# Altium schematic sheet big sheet.SchDoc: <Enter Sheet Title> (part 1 of 2) (continued)
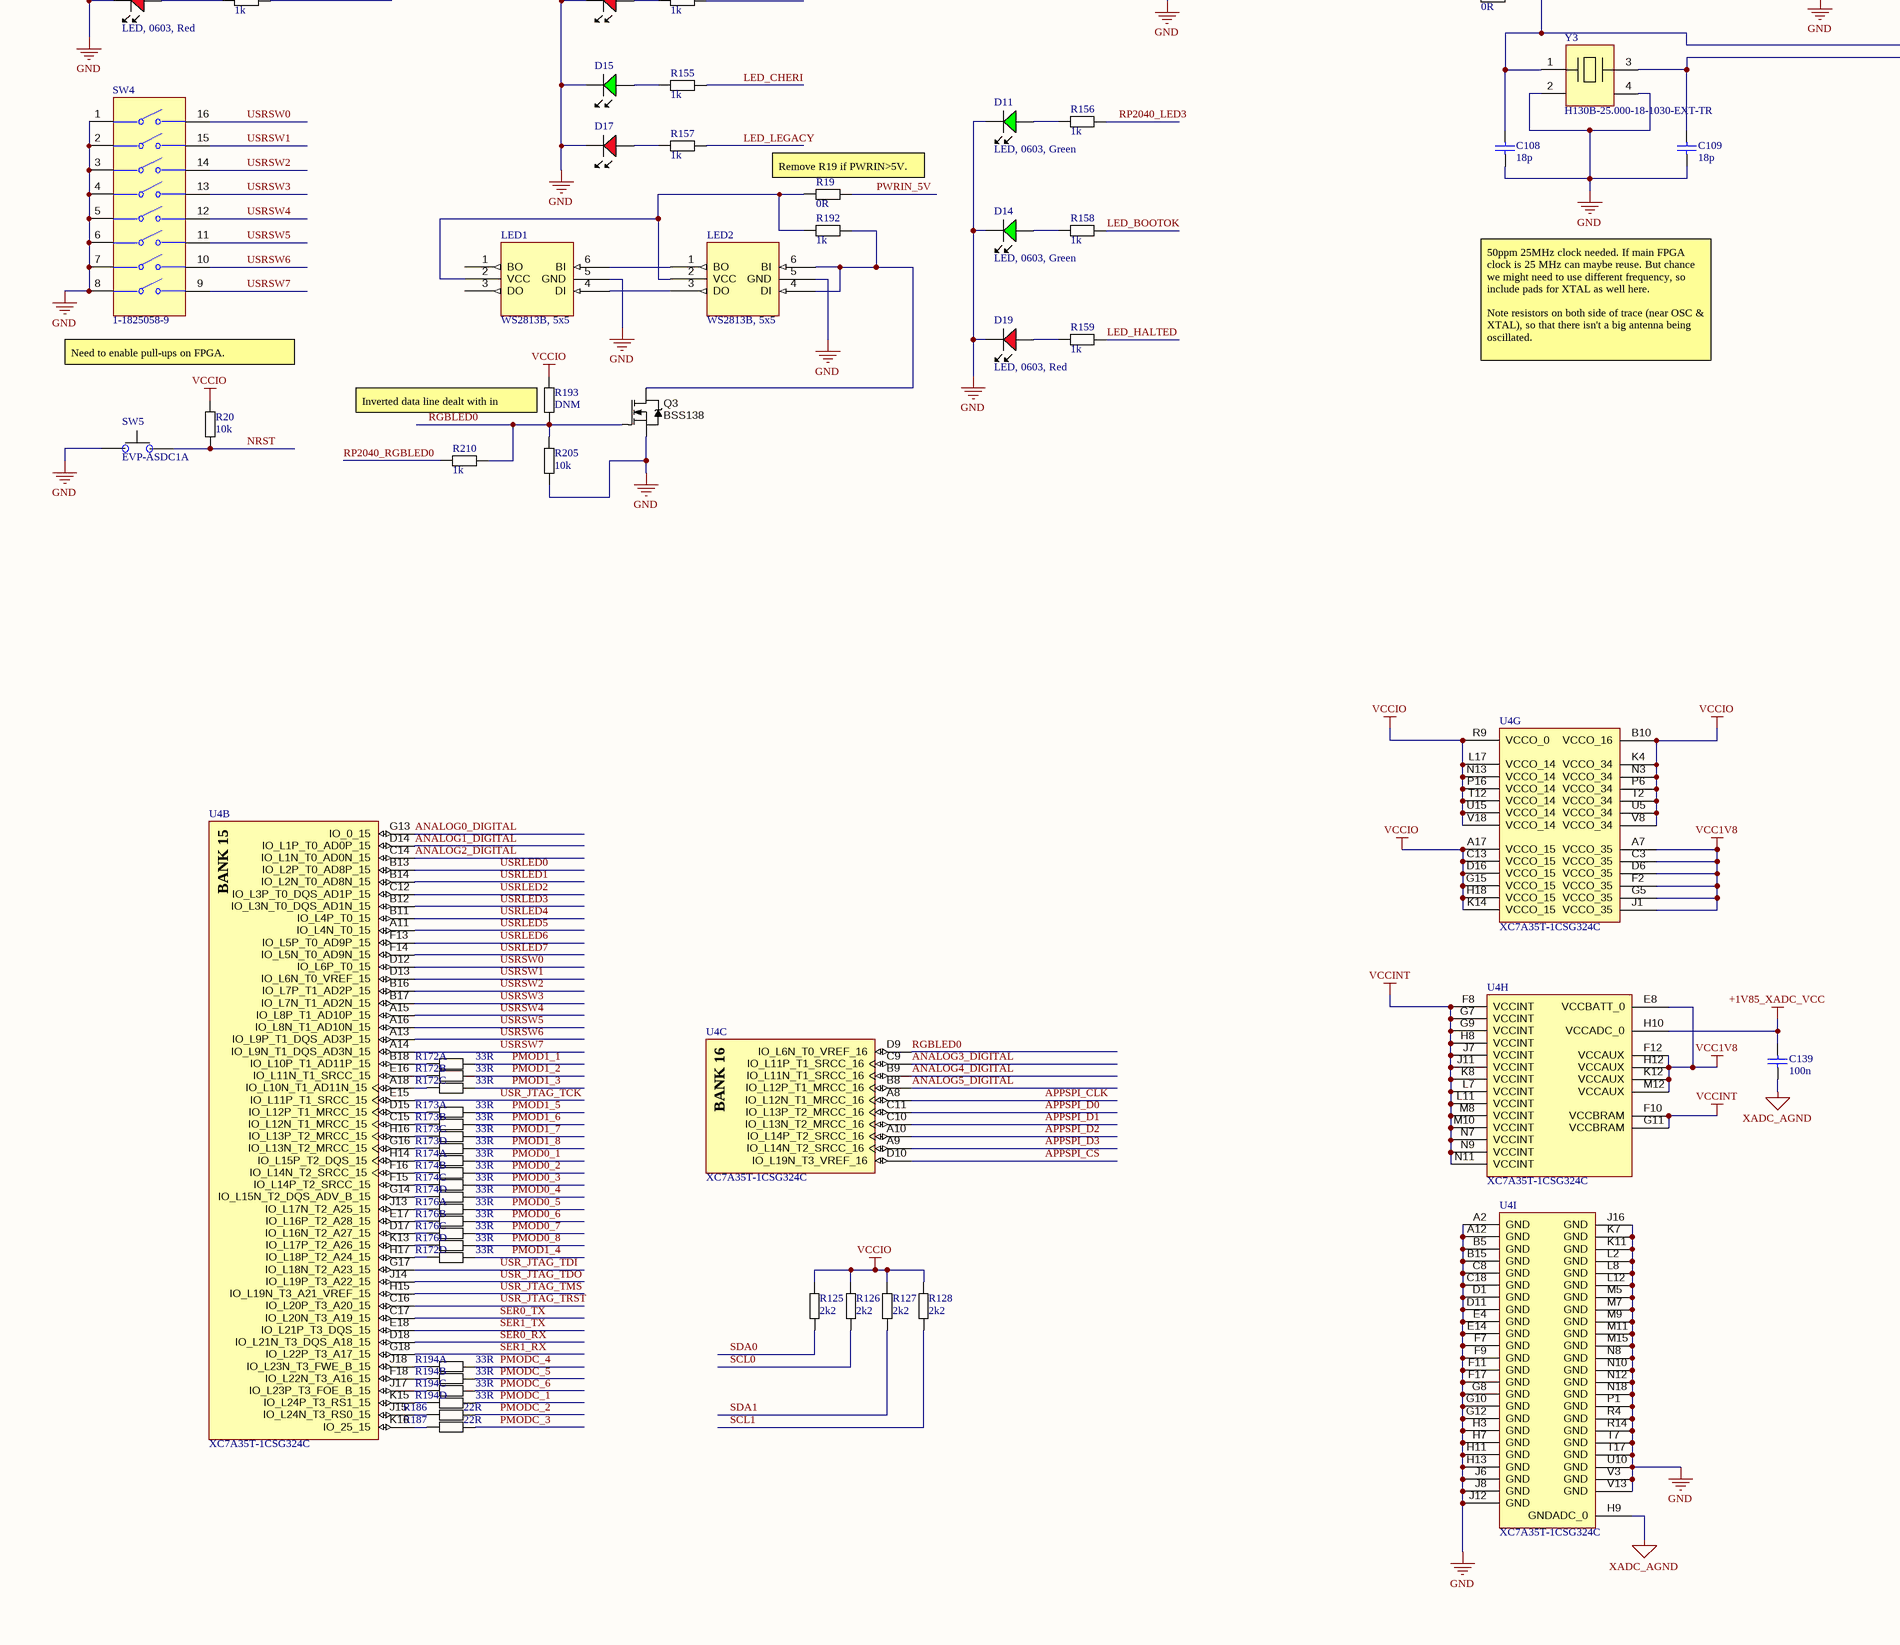
[diagram p5: big sheet.SchDoc, bottom column 2 of 4]
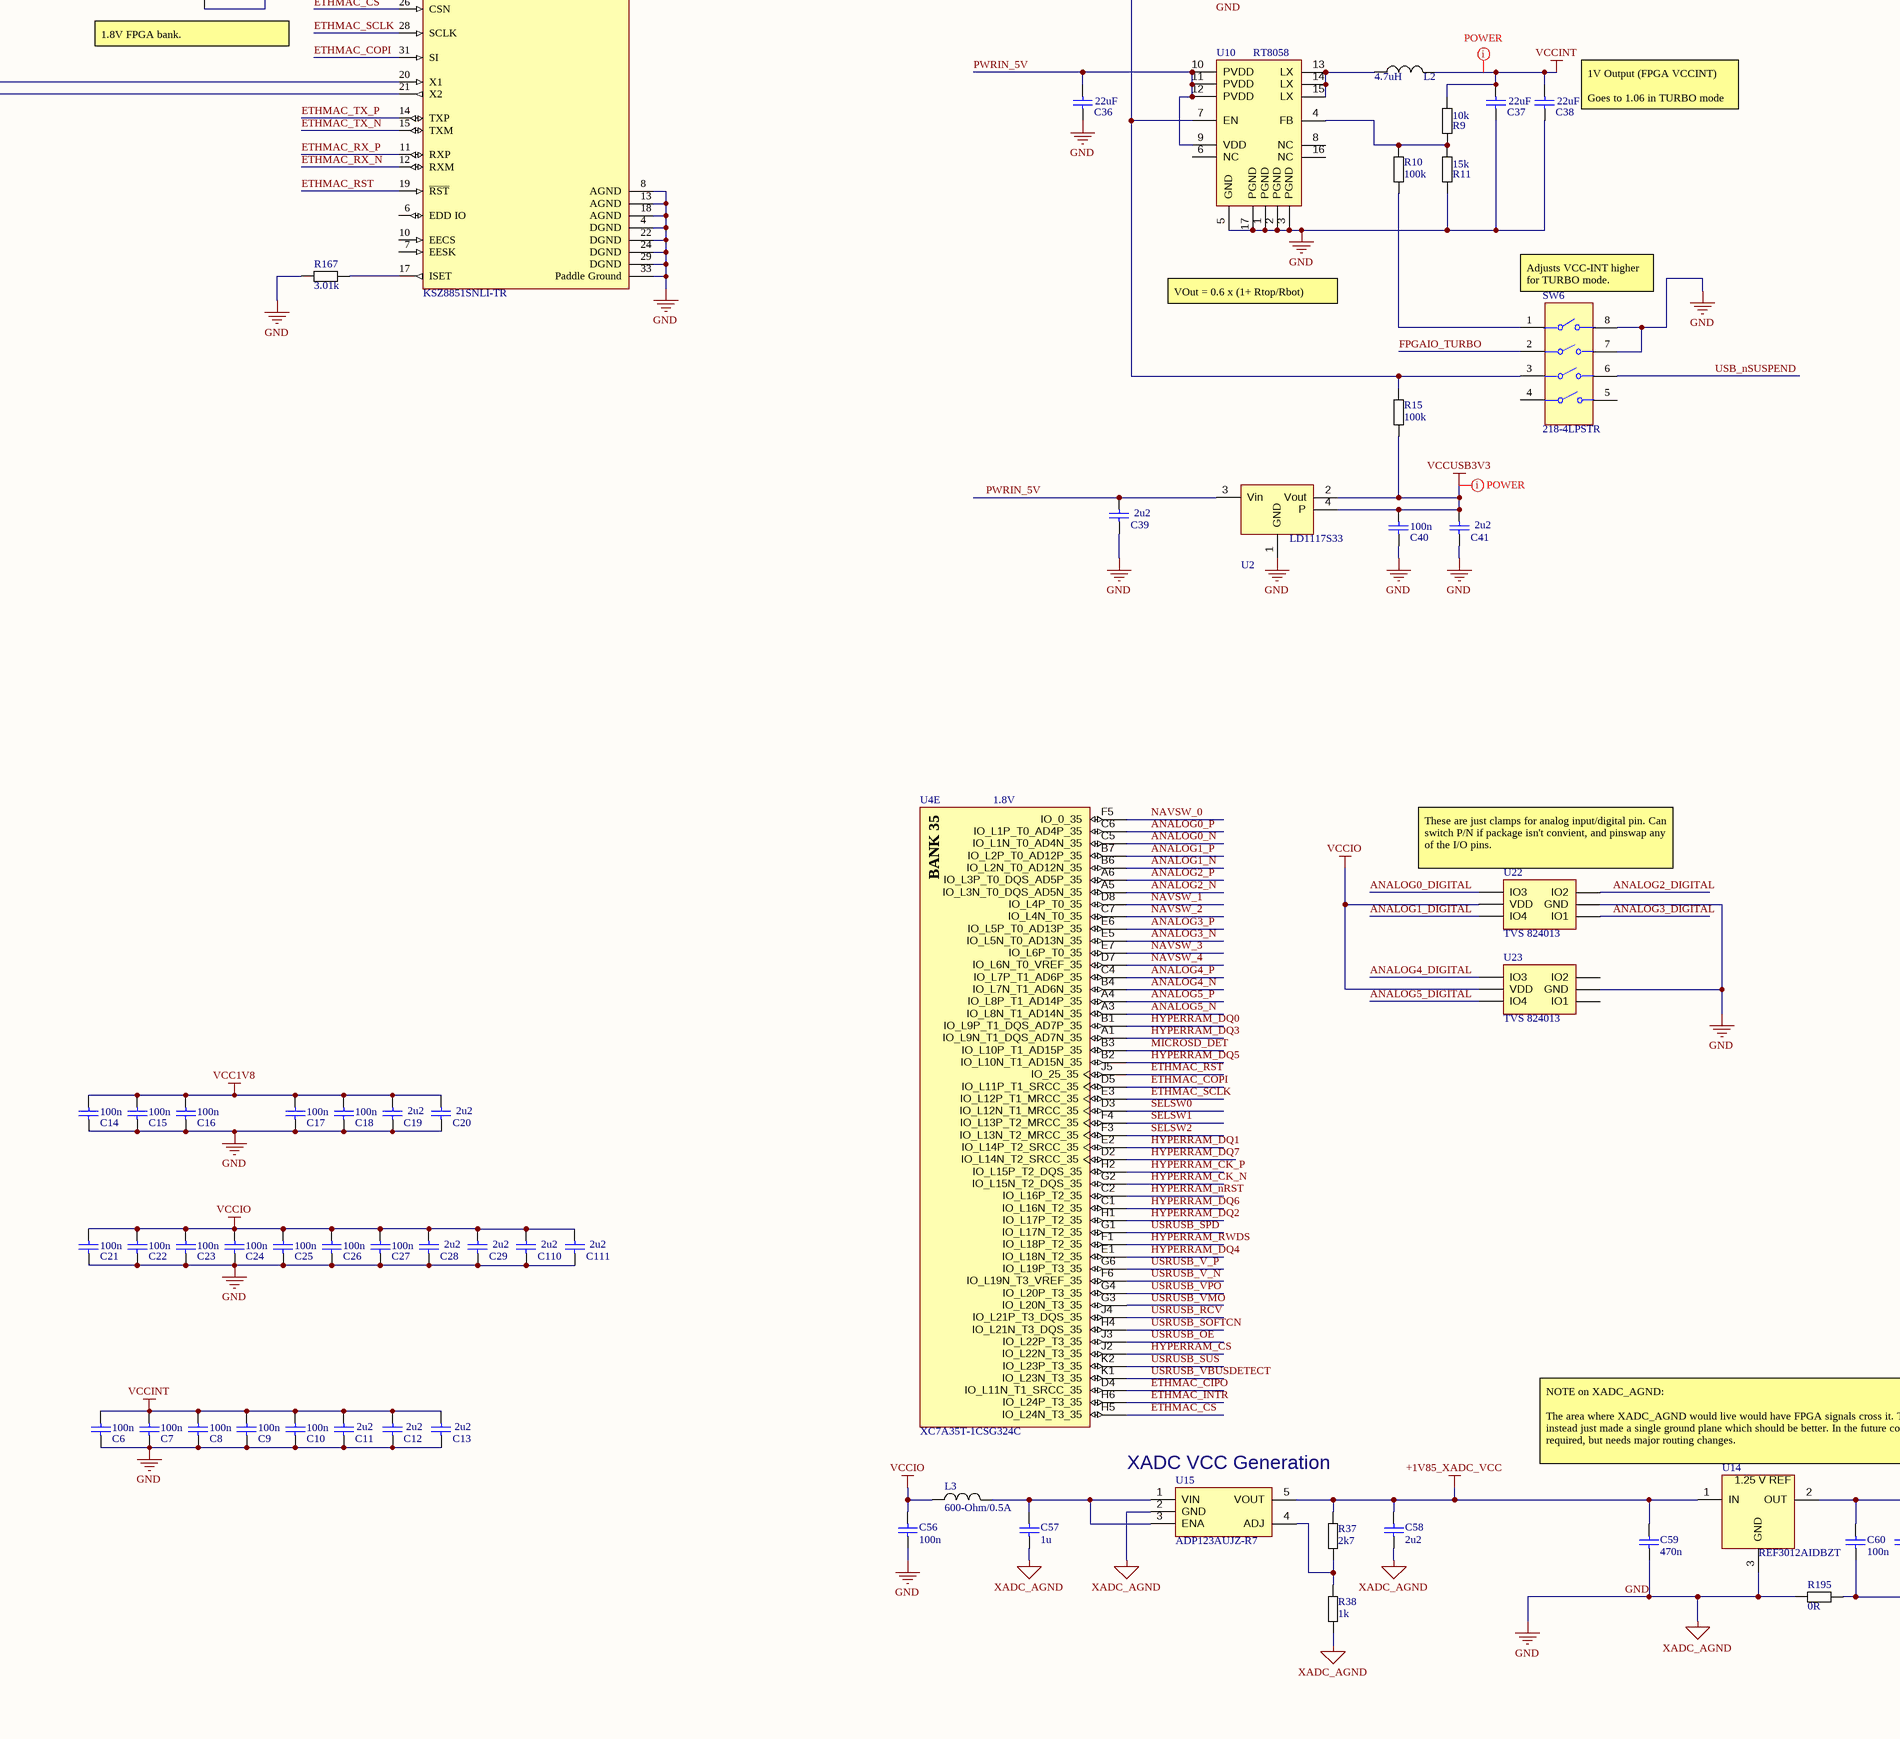
[diagram p6: big sheet.SchDoc, bottom column 3 of 4]
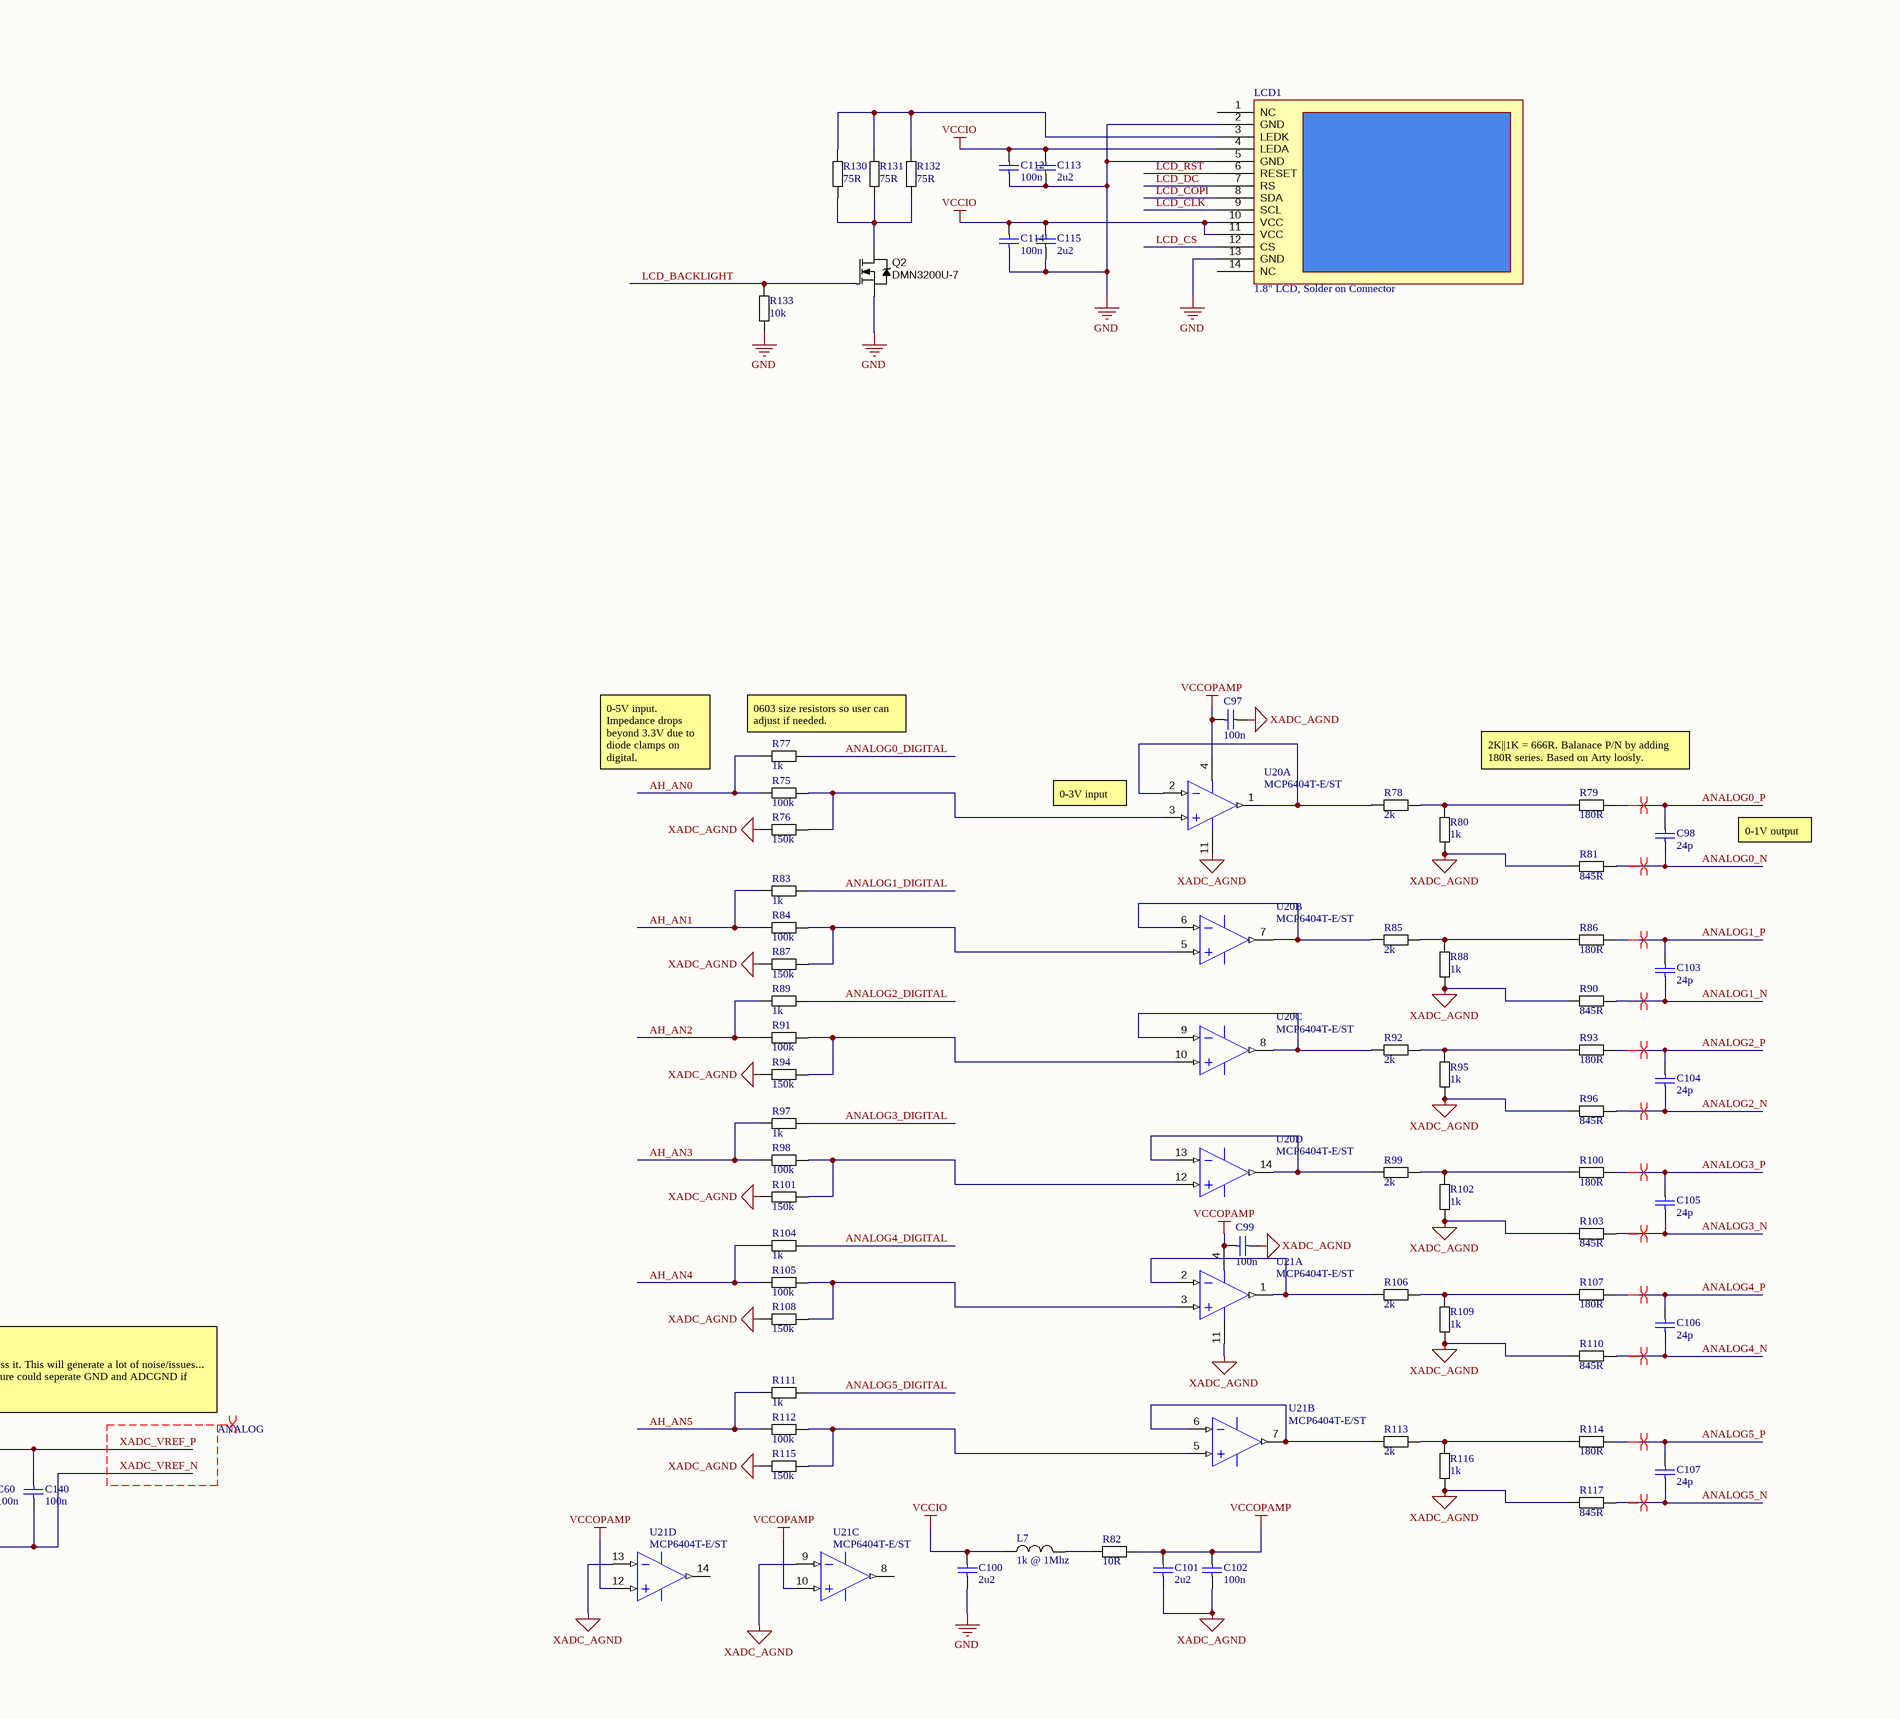
[diagram p7: big sheet.SchDoc, bottom column 4 of 4]

## Parts
C1  2u2  [CAPC0603_M]
C2  2u2  [CAPC0603_M]
C3  2u2  [CAPC0603_M]
C4  100n  [CAPC0402_M]
C5  680uF  [Cap_16v_680uF]  (value not drawn)
C6  100n  [CAPC0402_M]
C7  100n  [CAPC0402_M]
C8  100n  [CAPC0402_M]
C9  100n  [CAPC0402_M]
C10  100n  [CAPC0402_M]
C11  2u2  [CAPC0603_M]
C12  2u2  [CAPC0603_M]
C13  2u2  [CAPC0603_M]
C14  100n  [CAPC0402_M]
C15  100n  [CAPC0402_M]
C16  100n  [CAPC0402_M]
C17  100n  [CAPC0402_M]
C18  100n  [CAPC0402_M]
C19  2u2  [CAPC0603_M]
C20  2u2  [CAPC0603_M]
C21  100n  [CAPC0402_M]
C22  100n  [CAPC0402_M]
C23  100n  [CAPC0402_M]
C24  100n  [CAPC0402_M]
C25  100n  [CAPC0402_M]
C26  100n  [CAPC0402_M]
C27  100n  [CAPC0402_M]
C28  2u2  [CAPC0603_M]
C29  2u2  [CAPC0603_M]
C30  2u2  [CAPC0603_M]
C31  100n  [CAPC0402_M]
C32  2u2  [CAPC0603_M]
C33  22uF  [CAPC0805_M]
C34  22uF  [CAPC0805_M]
C35  22uF  [CAPC0805_M]
C36  22uF  [CAPC0805_M]
C37  22uF  [CAPC0805_M]
C38  22uF  [CAPC0805_M]
C39  2u2  [CAPC0603_M]
C40  100n  [CAPC0402_M]
C41  2u2  [CAPC0603_M]
C42  1u  [CAPC0603_M]
C43  100n  [CAPC0402_M]
C44  100n  [CAPC0402_M]
C45  1u  [CAPC0603_M]
C46  100n  [CAPC0402_M]
C47  1u  [CAPC0603_M]
C48  100n  [CAPC0402_M]
C49  100n  [CAPC0402_M]
C50  2u2  [CAPC0603_M]
C51  100n  [CAPC0402_M]
C52  100n  [CAPC0603_M]
C53  100n  [CAPC0402_M]
C54  100n  [CAPC0402_M]
C55  100n  [CAPC0402_M]
C56  100n  [CAPC0402_M]
C57  1u  [CAPC0603_M]
C58  2u2  [CAPC0603_M]
C59  470n  [CAPC0603_M]
C60  100n  [CAPC0402_M]
C61  100n  [CAPC0402_M]
C62  100n  [CAPC0402_M]
C63  100n  [CAPC0402_M]
C64  100n  [CAPC0402_M]
C65  100n  [CAPC0402_M]
C66  100n  [CAPC0402_M]
C67  100n  [CAPC0402_M]
C68  100n  [CAPC0402_M]
C69  2u2  [CAPC0603_M]
C70  2u2  [CAPC0603_M]
C71  100n  [CAPC0402_M]
C72  2u2  [CAPC0603_M]
C73  2u2  [CAPC0603_M]
C74  100n  [CAPC0402_M]
C75  100n  [CAPC0402_M]
C76  2u2  [CAPC0603_M]
C77  18p  [CAPC0402_M]
C78  18p  [CAPC0402_M]
C79  100n  [CAPC0402_M]
C80  100n  [CAPC0402_M]
C81  1u  [CAPC0603_M]
C82  1u  [CAPC0603_M]
C83  100n  [CAPC0402_M]
C84  100n  [CAPC0402_M]
C85  100n  [CAPC0402_M]
C86  100n  [CAPC0402_M]
C87  100n  [CAPC0402_M]
C88  100n  [CAPC0402_M]
C89  100n  [CAPC0402_M]
C90  100n  [CAPC0402_M]
C91  100n  [CAPC0402_M]
C92  18p  [CAPC0402_M]
C93  18p  [CAPC0402_M]
C94  100n  [CAPC0402_M]
C95  18p  [CAPC0402_M]
C96  18p  [CAPC0402_M]
C97  100n  [CAPC0402_M]
C98  24p  [CAPC0402_M]
C99  100n  [CAPC0402_M]
C100  2u2  [CAPC0603_M]
C101  2u2  [CAPC0603_M]
C102  100n  [CAPC0402_M]
C103  24p  [CAPC0402_M]
C104  24p  [CAPC0402_M]
C105  24p  [CAPC0402_M]
C106  24p  [CAPC0402_M]
C107  24p  [CAPC0402_M]
C108  18p  [CAPC0402_M]
C109  18p  [CAPC0402_M]
C110  2u2  [CAPC0603_M]
C111  2u2  [CAPC0603_M]
C112  100n  [CAPC0402_M]
C113  2u2  [CAPC0603_M]
C114  100n  [CAPC0402_M]
C115  2u2  [CAPC0603_M]
C116  100n  [CAPC0402_M]
C117  100n  [CAPC0402_M]
C118  100n  [CAPC0402_M]
C119  100n  [CAPC0402_M]
C120  100n  [CAPC0402_M]
C121  2u2  [CAPC0603_M]
C122  100n  [CAPC0402_M]
C123  2u2  [CAPC0603_M]
C124  2u2  [CAPC0603_M]
C125  2u2  [CAPC0603_M]
C126  2u2  [CAPC0603_M]
C127  100n  [CAPC0402_M]
C128  100n  [CAPC0402_M]
C129  100n  [CAPC0402_M]
C130  100n  [CAPC0402_M]
C131  100n  [CAPC0402_M]
C132  100n  [CAPC0402_M]
C133  100n  [CAPC0402_M]
C134  100n  [CAPC0402_M]
C135  100n  [CAPC0402_M]
C136  100n  [CAPC0402_M]
C137  100n  [CAPC0402_M]
C138  100n  [CAPC0402_M]
C139  100n  [CAPC0402_M]
C140  100n  [CAPC0402_M]
C141  100n  [CAPC0402_M]
C142  100n  [CAPC0402_M]
D3  LED, 0603, Blue  [LED-0603-BLUE]
D4  LED, 0603, Green  [LED-0603-GREEN]
D5  LED, 0603, Red  [LED-0603-RED]
D6  LED, 0603, Blue  [LED-0603-BLUE]
D7  LED, 0603, Green  [LED-0603-GREEN]
D8  LED, 0603, Red  [LED-0603-RED]
D9  LED, 0603, Green  [LED-0603-GREEN]
D10  LED, 0603, Red  [LED-0603-RED]
D11  LED, 0603, Green  [LED-0603-GREEN]
D12  LED, 0603, Red  [LED-0603-RED]  (value not drawn)
D13  LED, 0603, Red  [LED-0603-RED]  (value not drawn)
D14  LED, 0603, Green  [LED-0603-GREEN]
D15  LED, 0603, Green  [LED-0603-GREEN]  (value not drawn)
D16  LED, 0603, Red  [LED-0603-RED]  (value not drawn)
D17  LED, 0603, Red  [LED-0603-RED]  (value not drawn)
D18  LED, 0603, Red  [LED-0603-RED]  (value not drawn)
D19  LED, 0603, Red  [LED-0603-RED]
D20  LED, 0603, Red  [LED-0603-RED]  (value not drawn)
D22  LED, 0603, Red  [LED-0603-RED]  (value not drawn)
D23  LED, 0603, Red  [LED-0603-RED]  (value not drawn)
D24  LED, 0603, Red  [LED-0603-RED]  (value not drawn)
D25  LED, 0603, Red  [LED-0603-RED]  (value not drawn)
D26  LED, 0603, Green  [LED-0603-GREEN]  (value not drawn)
D27  LED, 0603, Green  [LED-0603-GREEN]  (value not drawn)
D28  LED, 0603, Green  [LED-0603-GREEN]  (value not drawn)
E1  1912320000  [PS_3_5_90_02]
E2  1912330000  [PS_3_5_90_03]
E3  1912330000  [PS_3_5_90_03]
IC1  W956D8MBYA5I  [BGA24C100P5X5_600X800X120]
J1  SM04B-SRSS-TB_LF__SN_  [SM04B-SRSS-TB(LFSN)]
J2  USB4105-GF-A  [FP-USB4105-GF-A-MFG]
J3  J00-0045NL  [FP-J00-0045NL-MFG]  (parts A,B,C of 3)
J4  10 Pin Cortex Program & Debug  [0.5mm_SMD_Header_5x2]
J5  PN  [CONN_10x2_SHROUDED_2.54mm]
J6  USB4105-GF-A  [FP-USB4105-GF-A-MFG]
J7  SM04B-SRSS-TB_LF__SN_  [SM04B-SRSS-TB(LFSN)]
L1  4.7uH  [NR6028]
L2  4.7uH  [NR6028]
L3  600-Ohm/0.5A  [IND_0603]
L5  1k @ 1Mhz  [IND_0603]
L6  1k @ 1Mhz  [IND_0603]
L7  1k @ 1Mhz  [IND_0603]
L8  1k @ 1Mhz  [IND_0603]
L9  1k @ 1Mhz  [IND_0603]
LCD1  1.8" LCD, Solder on Connector  [ADAFRUIT618]
LED1  WS2813B, 5x5  [WS2813B_5x5]
LED2  WS2813B, 5x5  [WS2813B_5x5]
MH1  M3, Tight Fit  [MOUNT_M3_TIGHT]
MH2  M3, Tight Fit  [MOUNT_M3_TIGHT]
MH3  M3, Tight Fit  [MOUNT_M3_TIGHT]
MH4  M3, Tight Fit  [MOUNT_M3_TIGHT]
MH5  M3, Tight Fit  [MOUNT_M3_TIGHT]
MH6  M3, Tight Fit  [MOUNT_M3_TIGHT]
MH7  M3, Tight Fit  [MOUNT_M3_TIGHT]
P1  Header 8  [HDR1X8_SLW-108-01-T-S]
P2  Header 8  [HDR1X8_SLW-108-01-T-S]
P3  Header 20X2  [HDR2X20_861400402YO2LF]
P4  Header 10  [HDR1X10_SLW-110-01-T-S]
P5  Header 6  [HDR1X6_SLW-106-01-T-S]
P6  Header 8  [HDR1X8_SLW-108-01-T-S]
P7  Header 8  [HDR1X8_SLW-108-01-T-S]
P8  Header 3X2A  [HDR2X3_CEN]
P9  Header 4  [HDR1X4]
P10  Header 3X2  [HDR2X3]
P11  Header 3X2  [HDR2X3_XG8T-0641]
P12  Header 4X2  [HDR2X4_XG8T-0841]
PMOD0  PMOD, 12-pin, RA, Through-Hole  [SAMTEC_SSW_106_02_X_D_RA_PMOD]
PMOD1  PMOD, 12-pin, RA, Through-Hole  [SAMTEC_SSW_106_02_X_D_RA_PMOD]
Q1  DMP2123LQ-7  [SOT95P245X110-3M]
Q2  DMN3200U-7  [SOT95P245X110-3M]
Q3  BSS138  [SOT95P245X110-3M]
Q4  DMP2123LQ-7  [SOT95P245X110-3M]
Q5  DMP2123LQ-7  [SOT95P245X110-3M]
R1  5k1  [RESC1608X55N]
R2  100k  [RESC1005X40N]
R3  10k  [RESC1005X40N]
R4  5k1  [RESC1608X55N]
R5  1k  [RESC1608X55N]
R6  1k  [RESC1608X55N]
R7  10k  [RESC1005X40N]
R8  2k2  [RESC1005X40N]
R9  10k  [RESC1005X40N]
R10  100k  [RESC1005X40N]
R11  15k  [RESC1005X40N]
R12  100k  [RESC1005X40N]
R13  100k  [RESC1005X40N]
R14  10k  [RESC1005X40N]
R15  100k  [RESC1608X55N]
R16  12k  [RESC1005X40N]
R17  100k  [RESC1608X55N]
R18  100k  [RESC1608X55N]
R19  0R  [RESC1608X55N]
R20  10k  [RESC1005X40N]
R21  1k  [RESC1608X55N]
R22  DNM RCHIP  [RESC1608X55N]
R23  47k  [RESC1005X40N]
R24  DNM RCHIP  [RESC1608X55N]
R25  22k  [RESC1005X40N]
R26  DNM RCHIP  [RESC1608X55N]
R27  33R  [RESC1608X55N]
R28  DNM RCHIP  [RESC1608X55N]
R29  33R  [RESC1608X55N]
R30  10k  [RESC1005X40N]
R31  1k5  [RESC1608X55N]
R32  10k  [RESC1005X40N]
R33  10R  [RESC1608X55N]
R34  DNM RCHIP  [RESC1608X55N]
R35  DNM RCHIP  [RESC1608X55N]
R36  DNM RCHIP  [RESC1608X55N]
R37  2k7  [RESC1005X40N]
R38  1k  [RESC1005X40N]
R39  1k  [RESC1608X55N]
R40  120R  [RESC1608X55N]
R41  DNM RCHIP  [RESC1608X55N]
R42  1k  [RESC1005X40N]
R43  12k  [RESC1608X55N]
R44  2k2  [RESC1005X40N]
R45  10k  [RESC1005X40N]
R46  10k  [RESC1005X40N]
R47  22R  [RESC1005X40N]
R48  22R  [RESC1005X40N]
R49  22R  [RESC1005X40N]
R50  22R  [RESC1005X40N]
R51  22R  [RESC1005X40N]
R52  22R  [RESC1005X40N]
R53  1k  [RESC1005X40N]
R54  10k  [RESC1005X40N]
R55  22R  [RESC1005X40N]
R56  27R  [RESC1005X40N]
R57  22R  [RESC1005X40N]
R58  27R  [RESC1005X40N]
R59  22R  [RESC1005X40N]
R60  22R  [RESC1005X40N]
R61  22R  [RESC1005X40N]
R62  10k  [RESC1005X40N]
R63  22R  [RESC1005X40N]
R64  10k  [RESC1005X40N]
R65  22R  [RESC1005X40N]
R66  22R  [RESC1005X40N]
R67  10k  [RESC1005X40N]
R68  22R  [RESC1005X40N]
R69  22R  [RESC1005X40N]
R70  22R  [RESC1005X40N]
R71  10k  [RESC1005X40N]
R72  100k  [RESC1608X55N]
R73  DNM  [RESC1005X40N]
R74  DNM  [RESC1005X40N]
R75  100k  [RESC1608X55N]
R76  150k  [RESC1608X55N]
R77  1k  [RESC1608X55N]
R78  2k  [RESC1005X40N]
R79  180R  [RESC1005X40N]
R80  1k  [RESC1005X40N]
R81  845R  [RESC1005X40N]
R82  10R  [RESC1608X55N]
R83  1k  [RESC1608X55N]
R84  100k  [RESC1608X55N]
R85  2k  [RESC1005X40N]
R86  180R  [RESC1005X40N]
R87  150k  [RESC1608X55N]
R88  1k  [RESC1005X40N]
R89  1k  [RESC1608X55N]
R90  845R  [RESC1005X40N]
R91  100k  [RESC1608X55N]
R92  2k  [RESC1005X40N]
R93  180R  [RESC1005X40N]
R94  150k  [RESC1608X55N]
R95  1k  [RESC1005X40N]
R96  845R  [RESC1005X40N]
R97  1k  [RESC1608X55N]
R98  100k  [RESC1608X55N]
R99  2k  [RESC1005X40N]
R100  180R  [RESC1005X40N]
R101  150k  [RESC1608X55N]
R102  1k  [RESC1005X40N]
R103  845R  [RESC1005X40N]
R104  1k  [RESC1608X55N]
R105  100k  [RESC1608X55N]
R106  2k  [RESC1005X40N]
R107  180R  [RESC1005X40N]
R108  150k  [RESC1608X55N]
R109  1k  [RESC1005X40N]
R110  845R  [RESC1005X40N]
R111  1k  [RESC1608X55N]
R112  100k  [RESC1608X55N]
R113  2k  [RESC1005X40N]
R114  180R  [RESC1005X40N]
R115  150k  [RESC1608X55N]
R116  1k  [RESC1005X40N]
R117  845R  [RESC1005X40N]
R118  100k  [RESC1005X40N]
R119  100k  [RESC1005X40N]
R120  100k  [RESC1005X40N]
R121  100k  [RESC1005X40N]
R122  0R  [RESC1608X55N]
R123  0R  [RESC1608X55N]
R124  0R  [RESC1608X55N]
R125  2k2  [RESC1608X55N]
R126  2k2  [RESC1608X55N]
R127  2k2  [RESC1608X55N]
R128  2k2  [RESC1608X55N]
R129  2k7  [RESC1005X40N]
R130  75R  [RESC2012X70N]
R131  75R  [RESC2012X70N]
R132  75R  [RESC2012X70N]
R133  10k  [RESC1005X40N]
R134  1k  [RESC1608X55N]
R135  100k  [RESC1005X40N]
R136  1k  [RESC1608X55N]
R137  1k  [RESC1608X55N]
R138  1k  [RESC1005X40N]
R139  1k  [RESC1005X40N]
R140  1k  [RESC1005X40N]
R141  1k  [RESC1005X40N]
R142  1k  [RESC1005X40N]
R143  1k  [RESC1005X40N]
R144  1k  [RESC1005X40N]
R145  1k  [RESC1005X40N]
R146  1k  [RESC1005X40N]
R147  1k  [RESC1005X40N]
R148  1k  [RESC1005X40N]
R149  1k  [RESC1005X40N]
R150  1k  [RESC1005X40N]
R151  1k  [RESC1005X40N]
R152  1k  [RESC1005X40N]
R153  1k  [RESC1005X40N]
R154  1k  [RESC1005X40N]
R155  1k  [RESC1005X40N]
R156  1k  [RESC1005X40N]
R157  1k  [RESC1005X40N]
R158  1k  [RESC1005X40N]
R159  1k  [RESC1005X40N]
R160  10k  [RESC1005X40N]
R161  10k  [RESC1005X40N]
R162  10k  [RESC1005X40N]
R163  10k  [RESC1005X40N]
R164  10k  [RESC1005X40N]
R165  10k  [RESC1005X40N]
R166  10k  [RESC1005X40N]
R167  3.01k  [RESC1005X40N]
R168  22R  [RESC1005X40N]
R169  22R  [RESC1005X40N]
R170  33R  [741C083]  (parts A,B,C,D of 4)
R171  22R  [RESC1005X40N]
R172  33R  [741C083]  (parts A,B,C,D of 4)
R173  33R  [741C083]  (parts A,B,C,D of 4)
R174  33R  [741C083]  (parts A,B,C,D of 4)
R175  33R  [741C083]  (parts A,B,C,D of 4)
R176  33R  [741C083]  (parts A,B,C,D of 4)
R177  33R  [741C083]  (parts A,B,C,D of 4)
R178  33R  [741C083]  (parts A,B,C,D of 4)
R179  33R  [741C083]  (parts A,B,C,D of 4)
R180  33R  [741C083]  (parts A,B,C,D of 4)
R181  33R  [741C083]  (parts A,B,C,D of 4)
R182  33R  [741C083]  (parts A,B,C,D of 4)
R183  33R  [741C083]  (parts A,B,C,D of 4)
R184  33R  [741C083]  (parts A,B,C,D of 4)
R185  33R  [741C083]  (parts A,B,C,D of 4)
R186  22R  [RESC1005X40N]
R187  22R  [RESC1005X40N]
R188  33R  [741C083]  (parts A,B,C,D of 4)
R189  33R  [741C083]  (parts A,B,C,D of 4)
R190  33R  [741C083]  (parts A,B,C,D of 4)
R191  33R  [741C083]  (parts A,B,C,D of 4)
R192  1k  [RESC1005X40N]
R193  DNM  [RESC1005X40N]
R194  33R  [741C083]  (parts A,B,C,D of 4)
R195  0R  [RESC1005X40N]
R196  49R9  [RESC2012X70N]
R197  49R9  [RESC2012X70N]
R198  49R9  [RESC2012X70N]
R199  10k  [RESC1005X40N]
R200  1k  [RESC1005X40N]
R201  1k  [RESC1005X40N]
R202  1k  [RESC1005X40N]
R203  DNM  [RESC1005X40N]
R204  49R9  [RESC2012X70N]
R205  10k  [RESC1005X40N]
R206  1k8  [RESC1608X55N]
R207  1k8  [RESC1608X55N]
R208  DNM RCHIP  [RESC1608X55N]
R209  DNM RCHIP  [RESC1608X55N]
R210  1k  [RESC1005X40N]
R211  10k  [RESC1005X40N]
R212  12k  [RESC1608X55N]
R213  DNM RCHIP  [RESC1608X55N]
SD1  DM3AT-SF-PEJM5  [FP-DM3AT-SF-PEJM5-MFG]
SJ1  NC  [SJ_3S_NC12]  (no BOM)
SJ2  NO  [SJ_2S_NO]  (no BOM)
SW1  218-4LPSTR  [FP-218-4LPSTR-MFG]
SW2  218-8LPST  [FP-218-8LPST-MFG]  (parts A,B,C,D,E,F,G,H of 8)
SW3  CUS-13TB  [FP-CUS-13TB-MFG]
SW4  1-1825058-9  [FP-1-1825058-9-MFG]
SW5  EVP-ASDC1A  [EVPAS]
SW6  218-4LPSTR  [FP-218-4LPSTR-MFG]
SW7  CUS-13TB  [FP-CUS-13TB-MFG]
SW8  2425755-1  [2425755-1]
SW9  KMR211GLFS  [FP-KMR211GLFS-MFG]
U1  PRTR5V0U2AX  [SOT143B]
U2  LD1117S33  [SOT-223]
U3  ISL83485IBZ-T  [SOIC8_NARROW]
U4  XC7A35T-1CSG324C  [CSG324]  (parts A,B,C,D,E,F,G,H,I of 9)
U5  FT4232HQ-Tray  [QFN64_2_N]
U6  KSZ8851SNLI-TR  [FP-QFN55-32LD-PL-5-IPC_C]
U7  MAX3221IPWR  [PW0016A_L]
U8  RT8058  [QFN16_50P300X300X100_HS-17M]
U9  LD1117S18  [SOT-223]
U10  RT8058  [QFN16_50P300X300X100_HS-17M]
U11  SC0914_7_  [QFN40P700X700X90-57N-D]
U12  USB2422-I/MJ  [FP-24-S4QFN-4x4B-0_5P-MFG]
U13  TUSB1106PWR  [PW0016A_L]  (parts A,B of 2)
U14  REF3012AIDBZT  [SOT95P237X112-3N]
U15  Linear Voltage Regulator IC  1 Output  300mA TSOT-5  [SOT23-5P95_285X145L45X40]  (value not drawn)
U16  AT93C46DN-SH-T  [FP-C04-057-SN-MFG]
U17  W25Q256JVEIQ  [WSON68_Micron]
U18  W25Q64JVZEIQ  [WSON68_Micron]
U19  W25Q256JVEIQ  [WSON68_Micron]
U20  MCP6404T-E/ST  [TSSOP-ST14_M]  (parts A,B,C,D of 4)
U21  MCP6404T-E/ST  [TSSOP-ST14_M]  (parts A,B,C,D of 4)
U22  TVS 824013  [SOT95P280X145-6N]
U23  TVS 824013  [SOT95P280X145-6N]
X1  ABM8G-24.000MHZ-4Y-T3  [ABM8G]
X2  ABM10AIG-12.000MHZ-4Z-T3  [2.5x2mm XTAL]
Y1  H130B-12.000-16-2525-EXT-TR  [5x3.2MM XTAL]
Y2  ASE-25.000MHZ-LC-T  [FP-ASE-MFG]
Y3  Manufacturer Part Number: H130B-25.000-18-1030-EXT-TR  [5x3.2MM XTAL]  (hidden comment: H130B-12.000-16-2525-EXT-TR)

## Blocks framed on the sheet
R-Pi Headers: P3 R206 R207
Arduino Headers (3.3V I/O only!): P1 P2 P4 P5 P11 SJ1
QWIIC (Sparkfun): J1 J7
PMOD Headers: P8 PMOD0 PMOD1
mikroBUS Click: P6 P7 R208 R209
